# EasyEDA Pro project Access Control Core.eprj, schematic RGB Screen

## Sheets
1 P1: Board Name: RGB Screen; Create Date: 2026-01-16; Page Name: P1; Project Name: ACS Core; Schematic Name: RGB Screen; Update Date: 2026-01-17; Company: EasyEDA.com; Page Size: A4; Version: V1.0
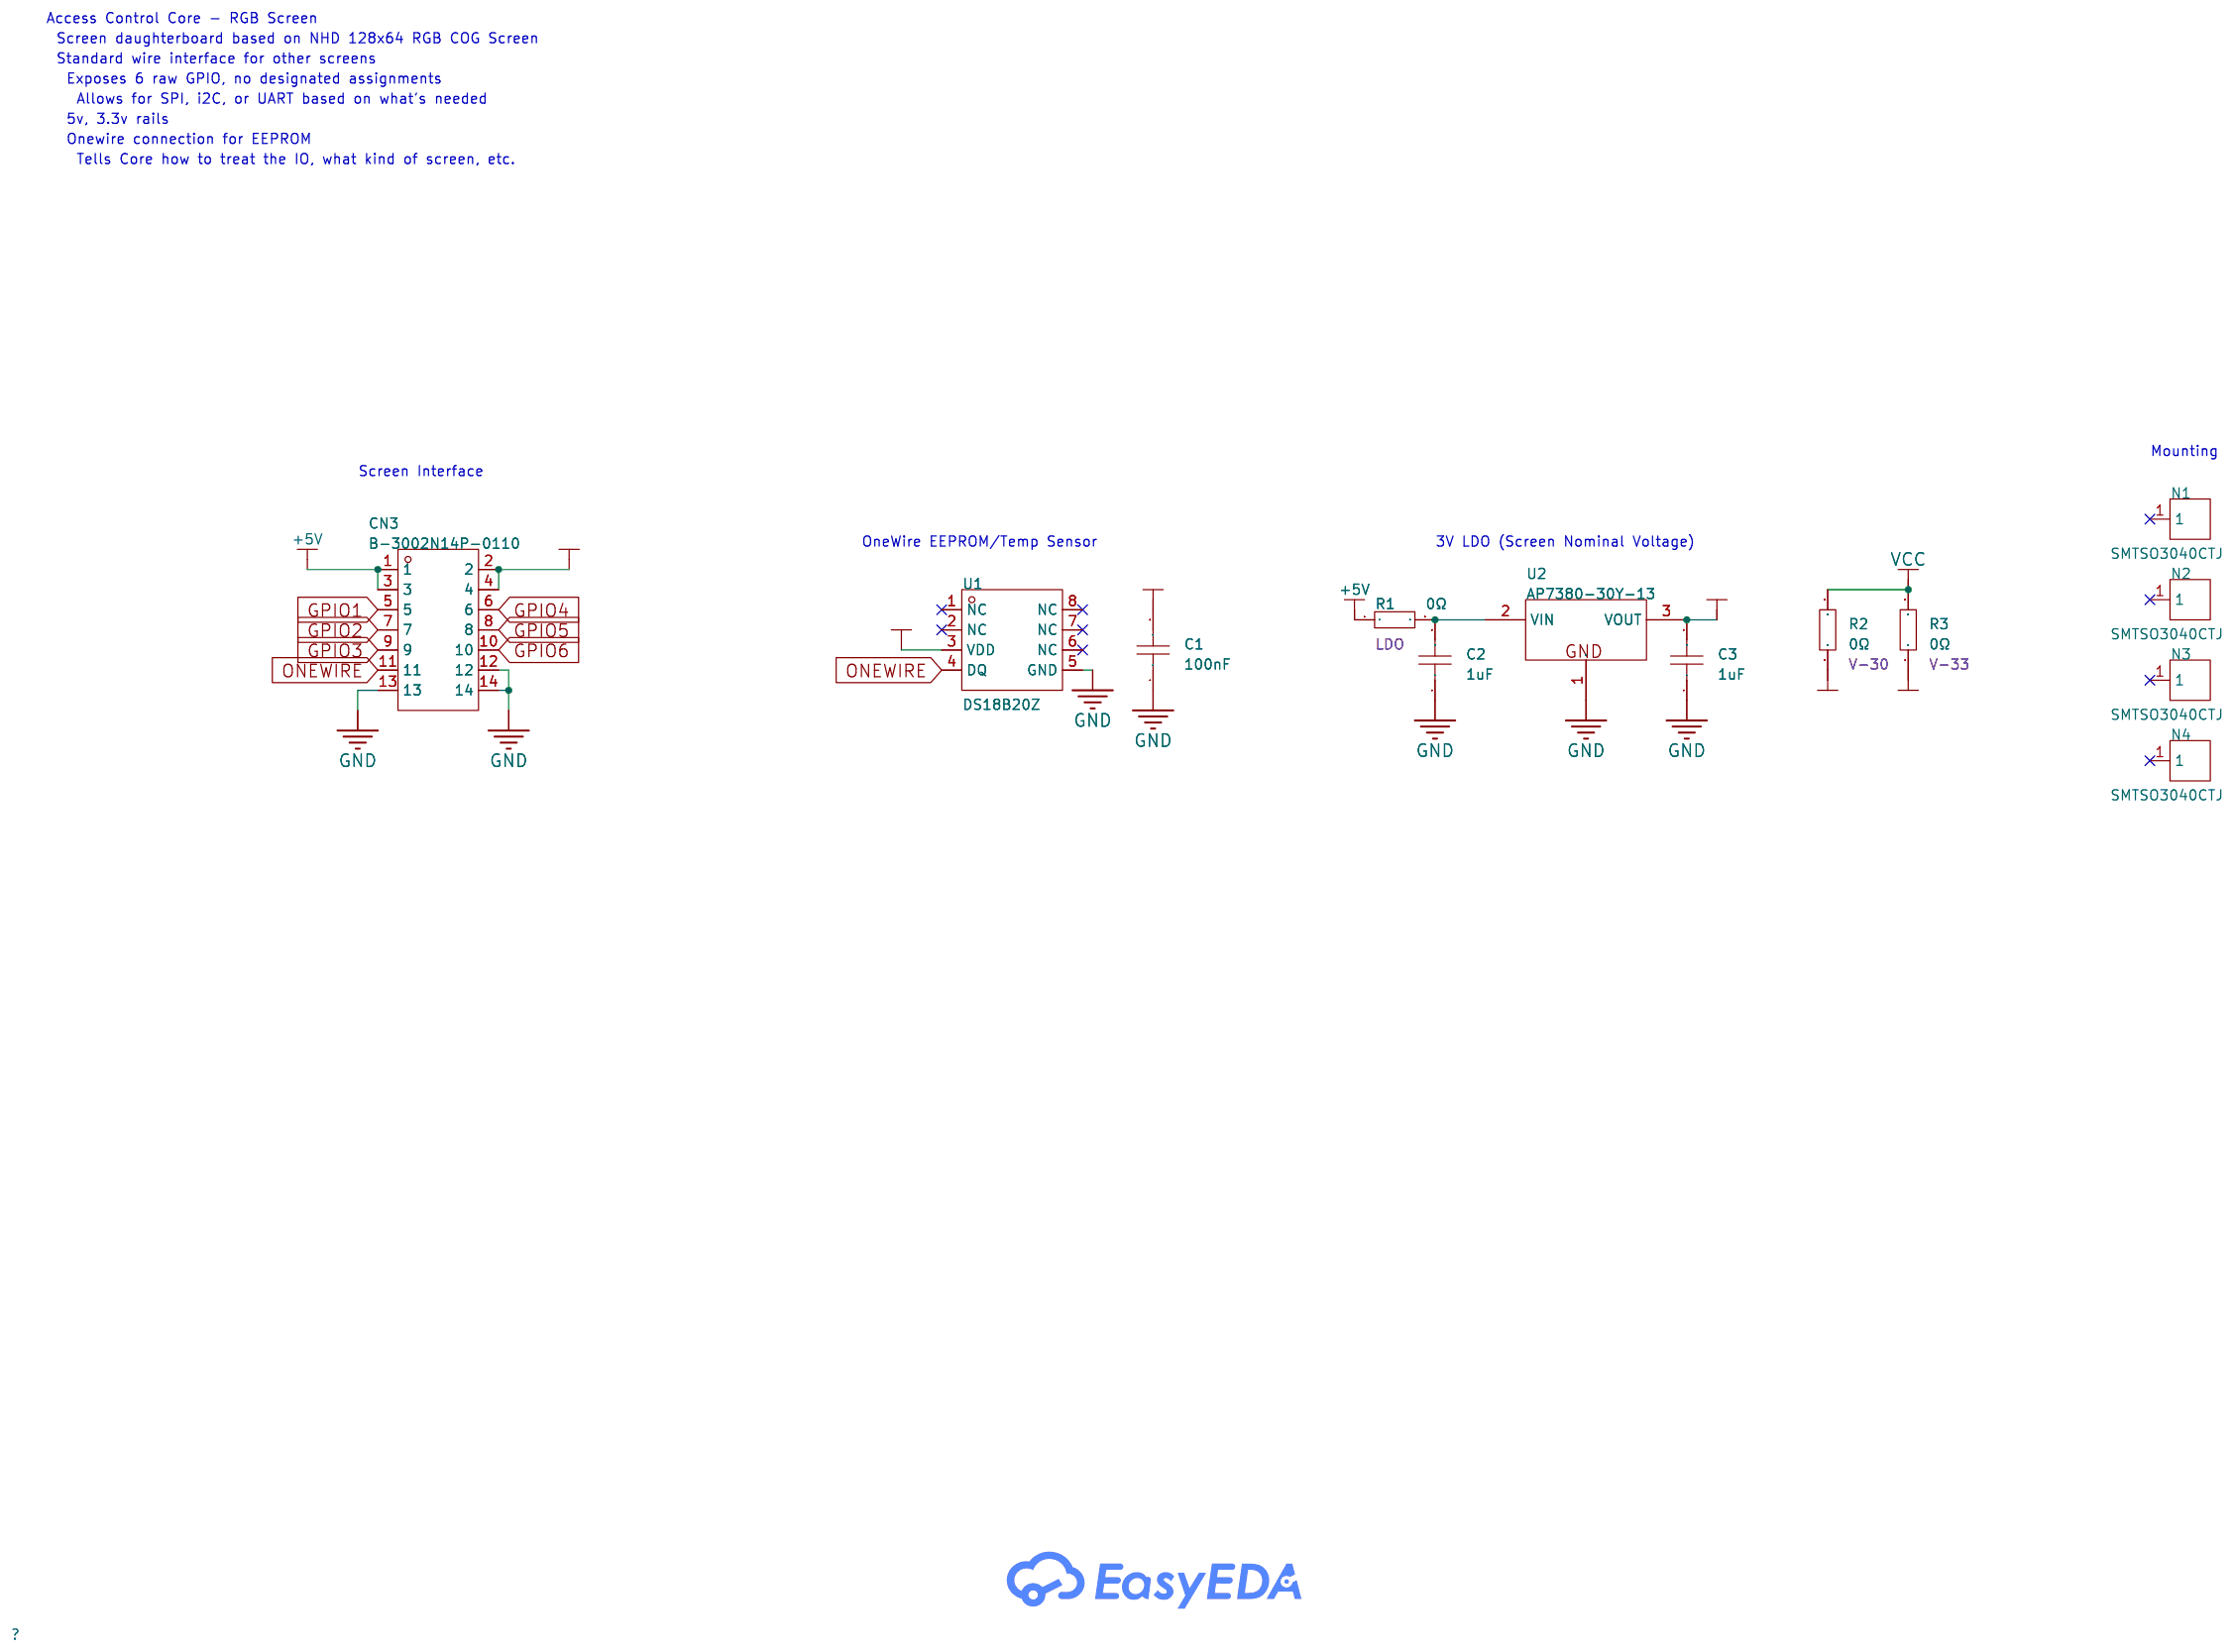
[diagram p7: P1]
2 Backlighting: Create Date: 2026-01-17; Page Name: Backlighting; Update Date: 2026-01-16
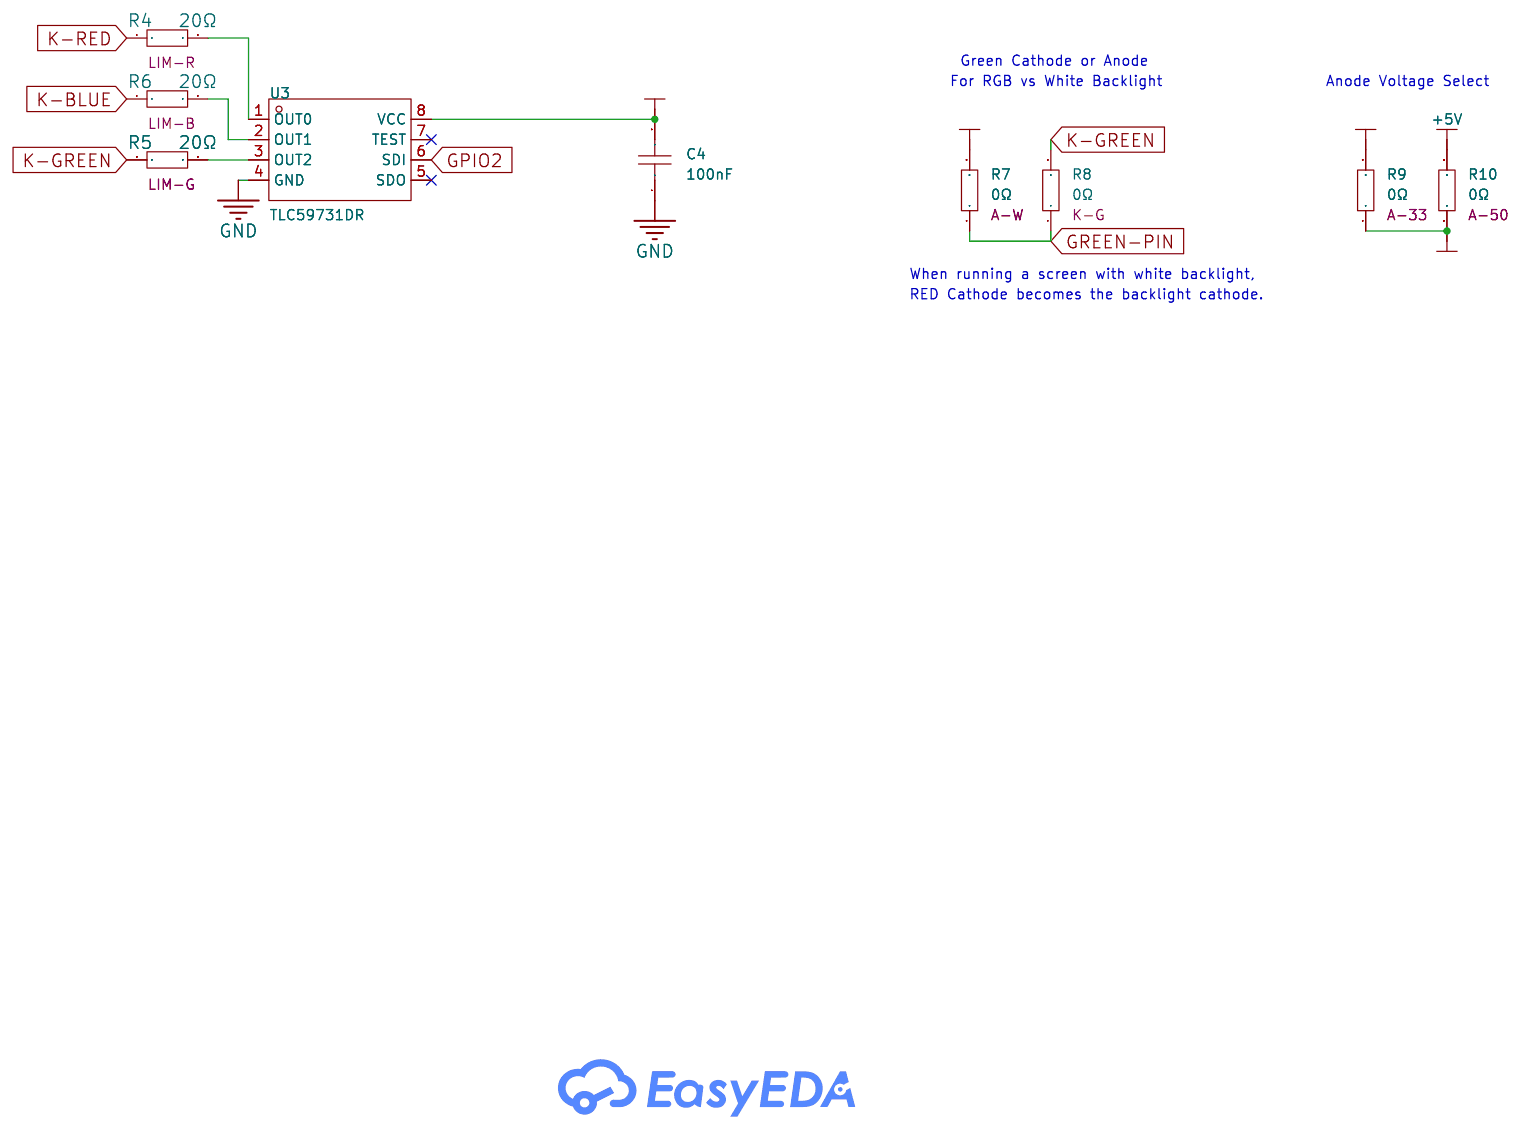
[diagram p8: Backlighting]
3 Screen: Create Date: 2026-01-17; Page Name: Screen; Update Date: 2026-01-16
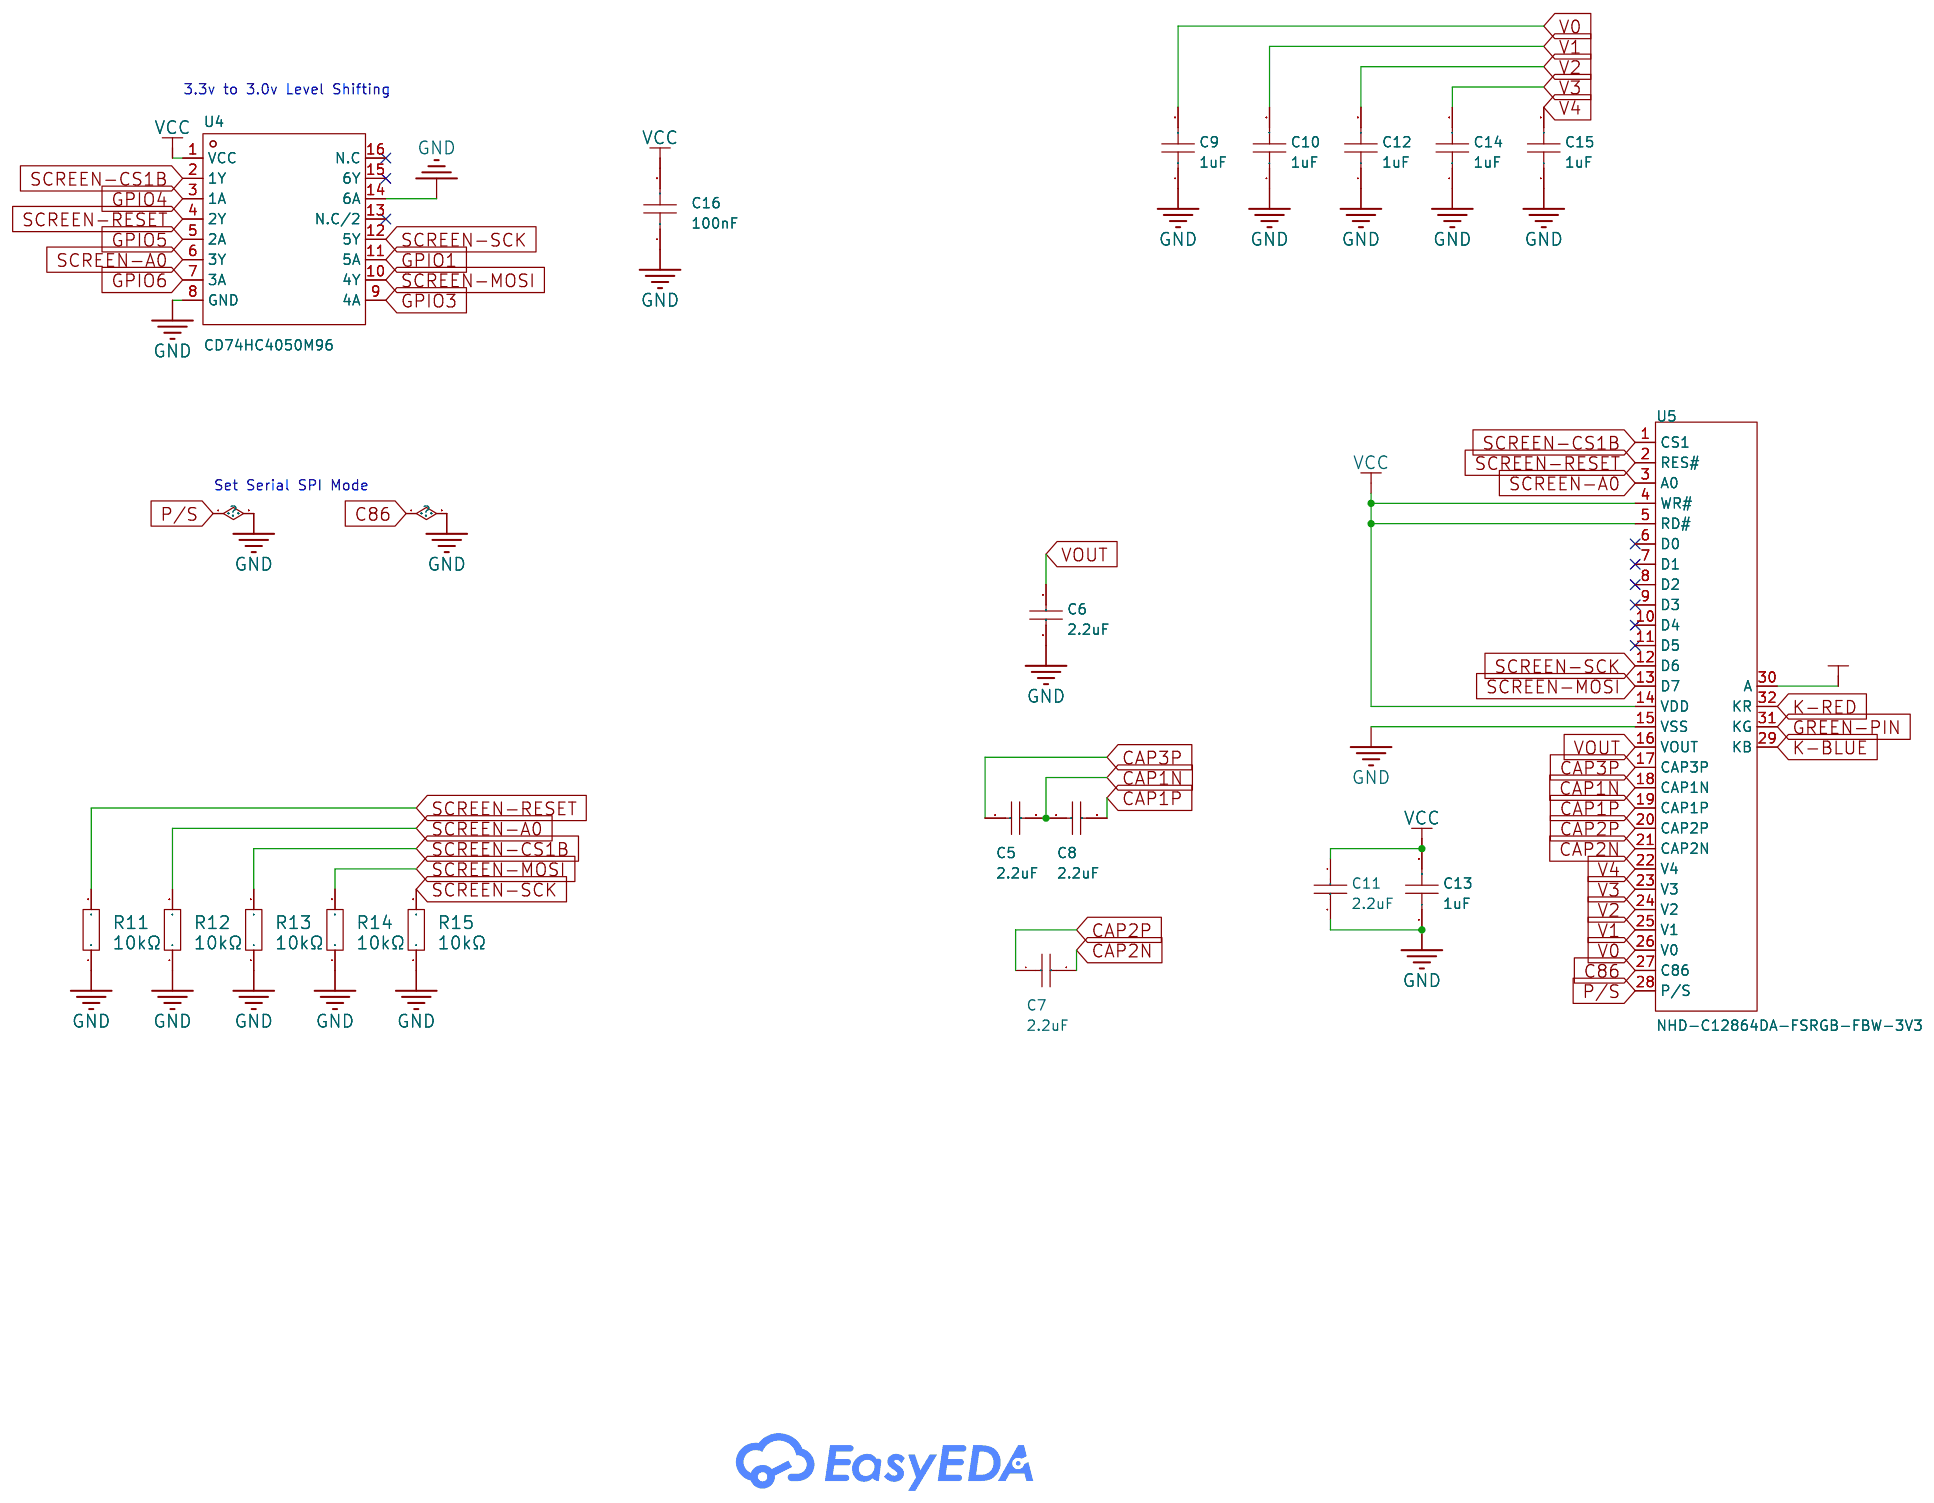
[diagram p9: Screen]

## Parts
sheet Backlighting
C4  100nF  [C0603]
R4  20Ω  [R1206]
R5  20Ω  [R1206]
R6  20Ω  [R1206]
R7  0Ω  [R0805]  (no BOM)
R8  0Ω  [R0805]
R9  0Ω  [R0805]
R10  0Ω  [R0805]  (no BOM)
U3  TLC59731DR  [SOIC-8_L4.9-W3.8-P1.27-LS6.0-BL]
sheet P1
C1  100nF  [C0603]
C2  1uF  [C0603]
C3  1uF  [C0603]
CN3  B-3002N14P-0110  [IDC-SMD_14P-P2.00_B-3002N14P-0110]
N1  SMTSO3040CTJ  [SMD-1_BD5.5-D4.0_H4.0]
N2  SMTSO3040CTJ  [SMD-1_BD5.5-D4.0_H4.0]
N3  SMTSO3040CTJ  [SMD-1_BD5.5-D4.0_H4.0]
N4  SMTSO3040CTJ  [SMD-1_BD5.5-D4.0_H4.0]
R1  0Ω  [R0805]
R2  0Ω  [R0805]
R3  0Ω  [R0805]  (no BOM)
U1  DS18B20Z  [SOP-8_L4.9-W3.9-P1.27-LS6.0-BL]
U2  AP7380-30Y-13  [SOT-89-3_L4.5-W2.5-P1.50-LS4.2-BR]
sheet Screen
C5  2.2uF  [C0603]
C6  2.2uF  [C0603]
C7  2.2uF  [C0603]
C8  2.2uF  [C0603]
C9  1uF  [C0603]
C10  1uF  [C0603]
C11  2.2uF  [C0603]
C12  1uF  [C0603]
C13  1uF  [C0603]
C14  1uF  [C0603]
C15  1uF  [C0603]
C16  100nF  [C0603]
R11  10kΩ  [R0603]
R12  10kΩ  [R0603]
R13  10kΩ  [R0603]
R14  10kΩ  [R0603]
R15  10kΩ  [R0603]
U4  CD74HC4050M96  [SOIC-16_L9.9-W3.9-P1.27-LS6.0-BL]
U5  NHD-C12864DA-FSRGB-FBW-3V3  [LCD-TH_L58.2-W41.7-P1.27_NHD-C12864DA-FSRGB-FBW-3V3]

## Library data of the parts
C1 C4 C16 = CC0603KRX7R9BB104: Capacitance: Tolerance:±10% Tolerance:±10% Voltage Rated: Temperature Coefficient:; LCSC Part Name: 100nF ±10% 50V; Supplier Part: C14663; Manufacturer: YAGEO(国巨); Supplier Footprint: 0603; JLCPCB Part Class: Basic Part; Datasheet: https://atta.szlcsc.com/upload/public/pdf/source/20180910/C282072_33301C7F631E79921B82A8DAC6BCC5B3.pdf; Supplier: LCSC; Tolerance: ±10%
R4 = 1206W4F200JT5E: LCSC Part Name: 20Ω ±1% 250mW 厚膜电阻; Supplier Part: C17955; Manufacturer: UNI-ROYAL(厚声); Supplier Footprint: 1206; Datasheet: https://item.szlcsc.com/datasheet/1206W4F200JT5E/18643.html; Supplier: LCSC; Type: Thick Film Resistor; Tolerance: ±1%; Power(Watts): 250mW; Voltage-Supply(Max): 200V; Temperature Coefficient: ±100ppm/℃; Operating Temperature: -55℃~+155℃; Note: LIM-R
R5 = 1206W4F200JT5E: LCSC Part Name: 20Ω ±1% 250mW 厚膜电阻; Supplier Part: C17955; Manufacturer: UNI-ROYAL(厚声); Supplier Footprint: 1206; Datasheet: https://item.szlcsc.com/datasheet/1206W4F200JT5E/18643.html; Supplier: LCSC; Type: Thick Film Resistor; Tolerance: ±1%; Power(Watts): 250mW; Voltage-Supply(Max): 200V; Temperature Coefficient: ±100ppm/℃; Operating Temperature: -55℃~+155℃; Note: LIM-G
R6 = 1206W4F200JT5E: LCSC Part Name: 20Ω ±1% 250mW 厚膜电阻; Supplier Part: C17955; Manufacturer: UNI-ROYAL(厚声); Supplier Footprint: 1206; Datasheet: https://item.szlcsc.com/datasheet/1206W4F200JT5E/18643.html; Supplier: LCSC; Type: Thick Film Resistor; Tolerance: ±1%; Power(Watts): 250mW; Voltage-Supply(Max): 200V; Temperature Coefficient: ±100ppm/℃; Operating Temperature: -55℃~+155℃; Note: LIM-B
R7 = 0805W8F0000T5E_C17477: Type:Thick Film Resistor Resistance:0Ω Tolerance:±1% Tolerance:±1% Power(Watts):125mW Voltage-Supply(Max):150V Temperature Coefficient:±800ppm/℃ Temperature Coefficient:±800ppm/℃ Operating Temperature:-55℃~+155℃ Operating Temperature:-55℃~+155℃; LCSC Part Name: 0Ω ±1% 125mW 厚膜电阻; Supplier Part: C17477; Manufacturer: UNI-ROYAL(厚声); Manufacturer Part: 0805W8F0000T5E; Supplier Footprint: 0805; Datasheet: https://item.szlcsc.com/datasheet/0805W8F0000T5E/18165.html; Supplier: LCSC; Type: Thick Film Resistor; Tolerance: ±1%; Power(Watts): 125mW; Voltage-Supply(Max): 150V; Temperature Coefficient: ±800ppm/℃; Operating Temperature: -55℃~+155℃; Note: A-W
R8 = 0805W8F0000T5E_C17477: Type:Thick Film Resistor Resistance:0Ω Tolerance:±1% Tolerance:±1% Power(Watts):125mW Voltage-Supply(Max):150V Temperature Coefficient:±800ppm/℃ Temperature Coefficient:±800ppm/℃ Operating Temperature:-55℃~+155℃ Operating Temperature:-55℃~+155℃; LCSC Part Name: 0Ω ±1% 125mW 厚膜电阻; Supplier Part: C17477; Manufacturer: UNI-ROYAL(厚声); Manufacturer Part: 0805W8F0000T5E; Supplier Footprint: 0805; Datasheet: https://item.szlcsc.com/datasheet/0805W8F0000T5E/18165.html; Supplier: LCSC; Type: Thick Film Resistor; Tolerance: ±1%; Power(Watts): 125mW; Voltage-Supply(Max): 150V; Temperature Coefficient: ±800ppm/℃; Operating Temperature: -55℃~+155℃; Note: K-G
R9 = 0805W8F0000T5E_C17477: Type:Thick Film Resistor Resistance:0Ω Tolerance:±1% Tolerance:±1% Power(Watts):125mW Voltage-Supply(Max):150V Temperature Coefficient:±800ppm/℃ Temperature Coefficient:±800ppm/℃ Operating Temperature:-55℃~+155℃ Operating Temperature:-55℃~+155℃; LCSC Part Name: 0Ω ±1% 125mW 厚膜电阻; Supplier Part: C17477; Manufacturer: UNI-ROYAL(厚声); Manufacturer Part: 0805W8F0000T5E; Supplier Footprint: 0805; Datasheet: https://item.szlcsc.com/datasheet/0805W8F0000T5E/18165.html; Supplier: LCSC; Type: Thick Film Resistor; Tolerance: ±1%; Power(Watts): 125mW; Voltage-Supply(Max): 150V; Temperature Coefficient: ±800ppm/℃; Operating Temperature: -55℃~+155℃; Note: A-33
R10 = 0805W8F0000T5E_C17477: Type:Thick Film Resistor Resistance:0Ω Tolerance:±1% Tolerance:±1% Power(Watts):125mW Voltage-Supply(Max):150V Temperature Coefficient:±800ppm/℃ Temperature Coefficient:±800ppm/℃ Operating Temperature:-55℃~+155℃ Operating Temperature:-55℃~+155℃; LCSC Part Name: 0Ω ±1% 125mW 厚膜电阻; Supplier Part: C17477; Manufacturer: UNI-ROYAL(厚声); Manufacturer Part: 0805W8F0000T5E; Supplier Footprint: 0805; Datasheet: https://item.szlcsc.com/datasheet/0805W8F0000T5E/18165.html; Supplier: LCSC; Type: Thick Film Resistor; Tolerance: ±1%; Power(Watts): 125mW; Voltage-Supply(Max): 150V; Temperature Coefficient: ±800ppm/℃; Operating Temperature: -55℃~+155℃; Note: A-50
U3 = TLC59731DR: LCSC Part Name: 具有单线制接口(EasySet)的三通道、8位、PWM LED驱动器; Supplier Part: C702091; Manufacturer: TI(德州仪器); Supplier Footprint: SOIC-8; JLCPCB Part Class: Extended Part; Datasheet: https://www.ti.com/cn/lit/gpn/tlc59731; Supplier: LCSC; Voltage - Input(DC): 3V~6V; Frequency - Switching: 6MHz; Number of Channels: 3; Output Voltage: 21V; Output Current: 50mA; Operating temperature: -40℃~+85℃
C2 C3 C9 C10 C12-C15 = CL10A105KB8NNNC: Capacitance: Tolerance:±10% Tolerance:±10% Voltage Rated: Temperature Coefficient:; LCSC Part Name: 1uF ±10% 50V; Supplier Part: C15849; Manufacturer: SAMSUNG(三星); Supplier Footprint: 0603; JLCPCB Part Class: Basic Part; Datasheet: https://atta.szlcsc.com/upload/public/pdf/source/20160218/1457707763339.pdf; Supplier: LCSC; Tolerance: ±10%; Temperature Coefficient: X5R; Voltage Rating: 50V
CN3 = B-3002N14P-0110: LCSC Part Name: 2mm 2x7P 排数:2 每排P数:7; Supplier Part: C383681; Manufacturer: Ckmtw(灿科盟); Supplier Footprint: SMD,P=2mm; JLCPCB Part Class: Extended Part; Datasheet: https://item.szlcsc.com/datasheet/B-3002N14P-0110/356941.html; Supplier: LCSC; Connector Type: IDC Header; Pitch: 2mm; Number of Positions or Pins: 2x7P; Holder Type: Surface Mount,Vertical; Row Spacing: 2mm; Number of Rows: 2; Number of PINs Per Row: 7; Contact Material: Brass; Contact Plating: Gold
N1-N4 = SMTSO3040CTJ: LCSC Part Name: 雄和远景，电路板表贴圆螺母柱，M3X4，铜镀锡,1个; Supplier Part: C2915635; Manufacturer: Sinhoo(雄和远景); Datasheet: https://atta.szlcsc.com/upload/public/pdf/source/20211122/17CF5E24EB4D4DC090A80DE3D7DE5E21.pdf; Supplier: LCSC; specifications: M3X4; surface treatment: 镀锡
R1 = 0805W8F0000T5E_C17477: Type:Thick Film Resistor Resistance:0Ω Tolerance:±1% Tolerance:±1% Power(Watts):125mW Voltage-Supply(Max):150V Temperature Coefficient:±800ppm/℃ Temperature Coefficient:±800ppm/℃ Operating Temperature:-55℃~+155℃ Operating Temperature:-55℃~+155℃; LCSC Part Name: 0Ω ±1% 125mW 厚膜电阻; Supplier Part: C17477; Manufacturer: UNI-ROYAL(厚声); Manufacturer Part: 0805W8F0000T5E; Supplier Footprint: 0805; Datasheet: https://item.szlcsc.com/datasheet/0805W8F0000T5E/18165.html; Supplier: LCSC; Type: Thick Film Resistor; Tolerance: ±1%; Power(Watts): 125mW; Voltage-Supply(Max): 150V; Temperature Coefficient: ±800ppm/℃; Operating Temperature: -55℃~+155℃; Note: LDO
R2 = 0805W8F0000T5E_C17477: Type:Thick Film Resistor Resistance:0Ω Tolerance:±1% Tolerance:±1% Power(Watts):125mW Voltage-Supply(Max):150V Temperature Coefficient:±800ppm/℃ Temperature Coefficient:±800ppm/℃ Operating Temperature:-55℃~+155℃ Operating Temperature:-55℃~+155℃; LCSC Part Name: 0Ω ±1% 125mW 厚膜电阻; Supplier Part: C17477; Manufacturer: UNI-ROYAL(厚声); Manufacturer Part: 0805W8F0000T5E; Supplier Footprint: 0805; Datasheet: https://item.szlcsc.com/datasheet/0805W8F0000T5E/18165.html; Supplier: LCSC; Type: Thick Film Resistor; Tolerance: ±1%; Power(Watts): 125mW; Voltage-Supply(Max): 150V; Temperature Coefficient: ±800ppm/℃; Operating Temperature: -55℃~+155℃; Note: V-30
R3 = 0805W8F0000T5E_C17477: Type:Thick Film Resistor Resistance:0Ω Tolerance:±1% Tolerance:±1% Power(Watts):125mW Voltage-Supply(Max):150V Temperature Coefficient:±800ppm/℃ Temperature Coefficient:±800ppm/℃ Operating Temperature:-55℃~+155℃ Operating Temperature:-55℃~+155℃; LCSC Part Name: 0Ω ±1% 125mW 厚膜电阻; Supplier Part: C17477; Manufacturer: UNI-ROYAL(厚声); Manufacturer Part: 0805W8F0000T5E; Supplier Footprint: 0805; Datasheet: https://item.szlcsc.com/datasheet/0805W8F0000T5E/18165.html; Supplier: LCSC; Type: Thick Film Resistor; Tolerance: ±1%; Power(Watts): 125mW; Voltage-Supply(Max): 150V; Temperature Coefficient: ±800ppm/℃; Operating Temperature: -55℃~+155℃; Note: V-33
U1 = DS18B20Z: Resolution:±0.4℃ Resolution:±0.4℃ Supply Voltage:2.5V~5.5V Supply Voltage:2.5V~5.5V; LCSC Part Name: 温度传感器; Supplier Part: C695837; Manufacturer: UMW(友台半导体); Supplier Footprint: SOIC-8; JLCPCB Part Class: Extended Part; Datasheet: https://atta.szlcsc.com/upload/public/pdf/source/20231109/DC3DA9D47D486EF40A6E0F08B9A498E3.pdf; Supplier: LCSC; Resolution: ±0.4℃; Supply Voltage: 2.5V~5.5V
U2 = AP7380-30Y-13: LCSC Part Name: 宽输入电压范围150mA超低压差稳压器; Supplier Part: C555162; Manufacturer: DIODES(美台); Supplier Footprint: SOT-89-3; Datasheet: https://item.szlcsc.com/datasheet/AP7380-30Y-13/576697.html; Supplier: LCSC; Output Type: Fixed; Voltage - Supply: 24V; Output Voltage: 3V; Output Current: 150mA; Voltage Dropout: 1.5V@(150mA); standby current: 3uA; Features: Over Current Protection；Enable；Over Temperature Protection; Operating Temperature: -40℃~+125℃@(Tj); Output Configuration: Positive; Number of Outputs: 1
C5-C8 C11 = CL10A225KO8NNNC: Capacitance:2.2uF Tolerance:±10% Tolerance:±10% Voltage Rating:16V Temperature Coefficient:X5R; LCSC Part Name: 2.2uF ±10% 16V; Supplier Part: C23630; Manufacturer: SAMSUNG(三星); Supplier Footprint: 0603; Datasheet: https://item.szlcsc.com/datasheet/CL10A225KO8NNNC/24366.html; Supplier: LCSC; Tolerance: ±10%; Voltage Rating: 16V; Temperature Coefficient: X5R
R11-R15 = 0603WAF1002T5E: Type:Thick Film Resistors Resistance:10kΩ Tolerance:±1% Tolerance:±1% Power(Watts): Overload Voltage (Max): Temperature Coefficient:±100ppm/℃ Temperature Coefficient:±100ppm/℃ Operating Temperature Range:-55℃~+155℃ Operating Temperature Range:-55℃~+155℃; LCSC Part Name: 厚膜电阻 10kΩ ±1% 100mW; Supplier Part: C25804; Manufacturer: UNI-ROYAL(厚声); Supplier Footprint: 0603; JLCPCB Part Class: Basic Part; Datasheet: https://atta.szlcsc.com/upload/public/pdf/source/20200306/C422600_1E6D84923E4A46A82E41ADD87F860B5C.pdf; Supplier: LCSC; Type: Thick Film Resistors; Tolerance: ±1%; Temperature Coefficient: ±100ppm/℃; Operating Temperature Range: -55℃~+155℃
U4 = CD74HC4050M96: Supplier Part: C131932; Manufacturer: TI(德州仪器); Supplier Footprint: SOIC-16; JLCPCB Part Class: Extended Part; Datasheet: https://www.ti.com/cn/lit/gpn/cd74hc4050; Supplier: LCSC; output type: 推挽; Supply Voltage: 2V~6V; Number of Elements: 6; Number of Bits per Element: 1; Sink Current: 5.2mA; Source Current: 5.2mA; Logic Family: 74HC; Operating Temperature: -55℃~+125℃
U5 = NHD-C12864DA-FSRGB-FBW-3V3: Supplier Part: C9900242902; Supplier Footprint: 插件; Supplier: LCSC

## Nets
+3.0V: C3.2 R2.1 U2.3(VOUT)
+3.3V: C4.2 CN3.2 CN3.4 R3.1 R9.2 U3.8(VCC)
+5V: C1.2 CN3.1 CN3.3 R1.1 R10.2 U1.3(VDD)
GND: C1.1 C2.1 C3.1 C4.1 C6.2 C9.1 C10.1 C11.2 C12.1 C13.1 C14.1 C15.1 C16.1 CN3.12 CN3.13 CN3.14 R11.1 R12.1 R13.1 R14.1 R15.1 U1.5(GND) U2.1(GND) U3.4(GND) U4.8(GND) U4.14(6A) U5.15(VSS) U5.27(C86) U5.28(P/S)
V0: C9.2 U5.26(V0)
V1: C10.2 U5.25(V1)
V2: C12.2 U5.24(V2)
V3: C14.2 U5.23(V3)
V4: C15.2 U5.22(V4)
VCC: C11.1 C13.2 C16.2 R2.2 R3.2 U4.1(VCC) U5.4(WR#) U5.5(RD#) U5.14(VDD)
CAP1N: C5.2 C8.1 U5.18(CAP1N)
CAP1P: C8.2 U5.19(CAP1P)
CAP2N: C7.2 U5.21(CAP2N)
CAP2P: C7.1 U5.20(CAP2P)
CAP3P: C5.1 U5.17(CAP3P)
GPIO1: CN3.5 U4.11(5A)
GPIO2: CN3.7 U3.6(SDI)
GPIO3: CN3.9 U4.9(4A)
GPIO4: CN3.6 U4.3(1A)
GPIO5: CN3.8 U4.5(2A)
GPIO6: CN3.10 U4.7(3A)
GREEN-PIN: R7.1 R8.1 U5.31(KG)
K-BLUE: R6.1 U5.29(KB)
K-GREEN: R5.1 R8.2
K-RED: R4.1 U5.32(KR)
ONEWIRE: CN3.11 U1.4(DQ)
SCREEN-A0: R12.2 U4.6(3Y) U5.3(A0)
SCREEN-CS1B: R13.2 U4.2(1Y) U5.1(CS1)
SCREEN-MOSI: R14.2 U4.10(4Y) U5.13(D7)
SCREEN-RESET: R11.2 U4.4(2Y) U5.2(RES#)
SCREEN-SCK: R15.2 U4.12(5Y) U5.12(D6)
VANODE: R7.2 R9.1 R10.1 U5.30(A)
VOUT: C6.1 U5.16(VOUT)
$1N6241: C2.2 R1.2 U2.2(VIN)
$2N1559: R5.2 U3.3(OUT2)
$2N1563: R6.2 U3.2(OUT1)
$2N1570: R4.2 U3.1(OUT0)

Not connected (* = marked no-connect by the designer): N1 1*; N2 1*; N3 1*; N4 1*; U1 1(NC)* 2(NC)* 6(NC)* 7(NC)* 8(NC)*; U3 5(SDO)* 7(TEST)*; U4 13(N.C/2)* 15(6Y)* 16(N.C)*; U5 6(D0)* 7(D1)* 8(D2)* 9(D3)* 10(D4)* 11(D5)*

## Notes on the sheets
sheet 1
- Access Control Core - RGB Screen
- Screen daughterboard based on NHD 128x64 RGB COG Screen
- Standard wire interface for other screens
- Exposes 6 raw GPIO, no designated assignments
- Allows for SPI, i2C, or UART based on what's needed
- 5v, 3.3v rails
- Onewire connection for EEPROM
- Tells Core how to treat the IO, what kind of screen, etc.
- Screen Interface
- Mounting
- OneWire EEPROM/Temp Sensor
- 3V LDO (Screen Nominal Voltage)
sheet 2
- Green Cathode or Anode
- For RGB vs White Backlight
- Anode Voltage Select
- RED Cathode becomes the backlight cathode.
- When running a screen with white backlight,
sheet 3
- 3.3v to 3.0v Level Shifting
- Set Serial SPI Mode
